# EasyEDA Pro project Priestess.eprj

# Schematic Schematic2
Board Name: Board2; Create Date: 2025-12-09; Page Name: P1; Project Name: Priestess; Schematic Name: Schematic2; Update Date: 2025-12-10; Company: 嘉立创EDA; Page Size: A4; Version: V1.0
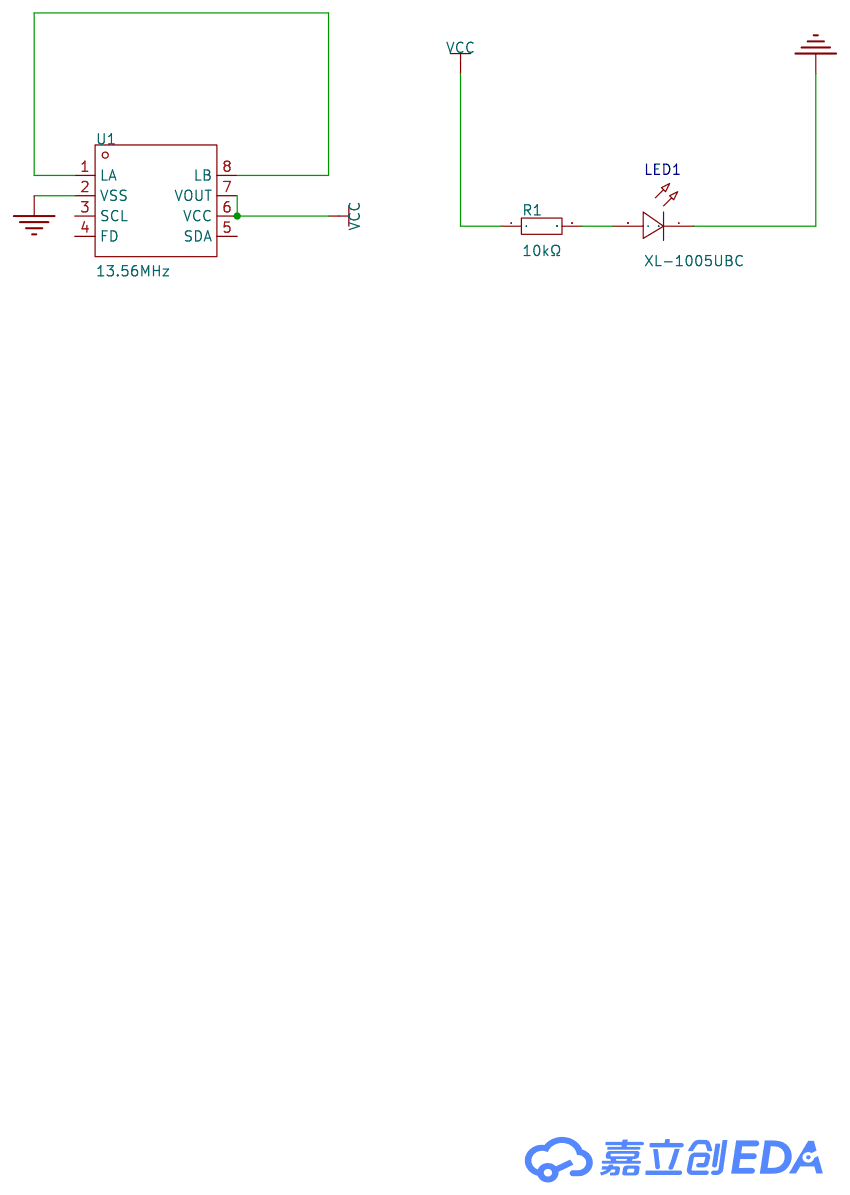
[diagram p0: schematic sheet]

## Parts
LED1  XL-1005UBC  [LED0402-RD]
R1  10kΩ  [R0402]
U1  13.56MHz  [XQFN-8_L1.6-W1.6-P0.50-BL_NT3H2111W0FHKH]

## Library data of the parts
LED1 = XL-1005UBC_C22355736: Supplier Part: C22355736; Manufacturer: XINGLIGHT(成兴光); Supplier Footprint: 0402; JLCPCB Part Class: Extended Part; Datasheet: https://item.szlcsc.com/datasheet/XL-1005UBC/23787446.html; Supplier: LCSC; Illumination Color: 蓝色; Voltage - Forward(Vf): 3.3V; Forward Current: 20mA; Wavelength - Dominant: 455nm~475nm; Peak Wavelength: 465nm; Lens Color: 无色透明透镜; Luminous Intensity: 240mcd; Viewing Angle: 120°; Mounting Style: 正贴
R1 = 0402WGF1002TCE: 电阻类型:厚膜电阻;阻值:10kΩ;精度:±1%;功率:62.5mW;最大工作电压:50V;温度系数:±100ppm/℃;; LCSC Part Name: 10kΩ ±1% 62.5mW 厚膜电阻; Supplier Part: C25744; Manufacturer: UNI-ROYAL(厚声); Supplier Footprint: 0402; JLCPCB Part Class: 基础库; Datasheet: https://atta.szlcsc.com/upload/public/pdf/source/20200306/C422600_1E6D84923E4A46A82E41ADD87F860B5C.pdf; Supplier: LCSC; Type: 厚膜电阻; Tolerance: ±1%; Power(Watts): 62.5mW; Overload Voltage (Max): 50V; Temperature Coefficient: ±100ppm/℃; Operating Temperature Range: -55℃~+155℃
U1 = NT3H2111W0FHKH: 协议:ISO 14443;接口类型:I2C;; Supplier Part: C710403; Manufacturer: NXP(恩智浦); Supplier Footprint: XQFN-8(1.6x1.6); JLCPCB Part Class: 扩展库; Datasheet: https://www.nxp.com/docs/en/data-sheet/NT3H2111_2211.pdf; Supplier: LCSC; agreement: ISO 14443; interface type: I2C; mains input: 3.3V

## Nets
GND: LED1.1(C) U1.2(VSS)
VCC: R1.1 U1.6(VCC) U1.7(VOUT)
$1N388: U1.1(LA) U1.8(LB)
$1N744: LED1.2(A) R1.2

Not connected (* = marked no-connect by the designer): U1 3(SCL) 4(FD) 5(SDA)

# Board PCB2
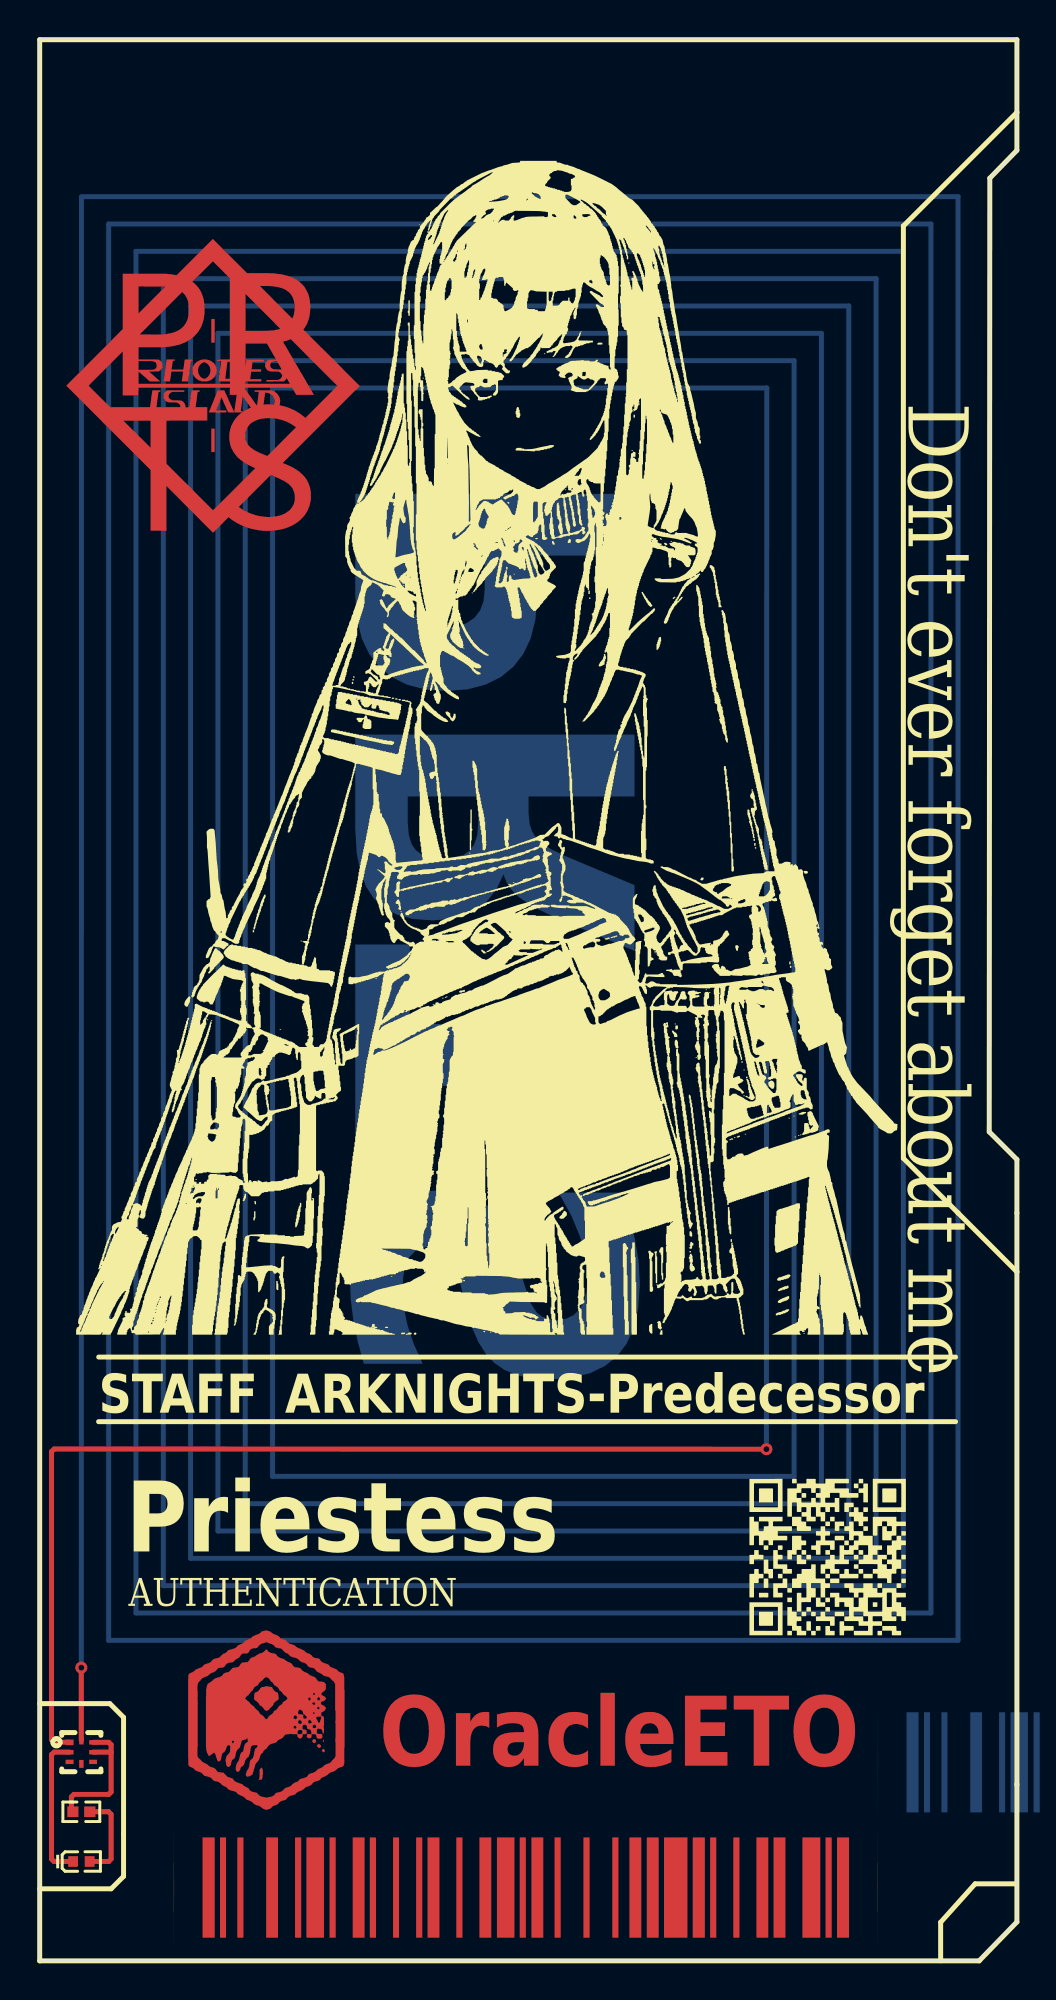
[diagram p1: board, top side]
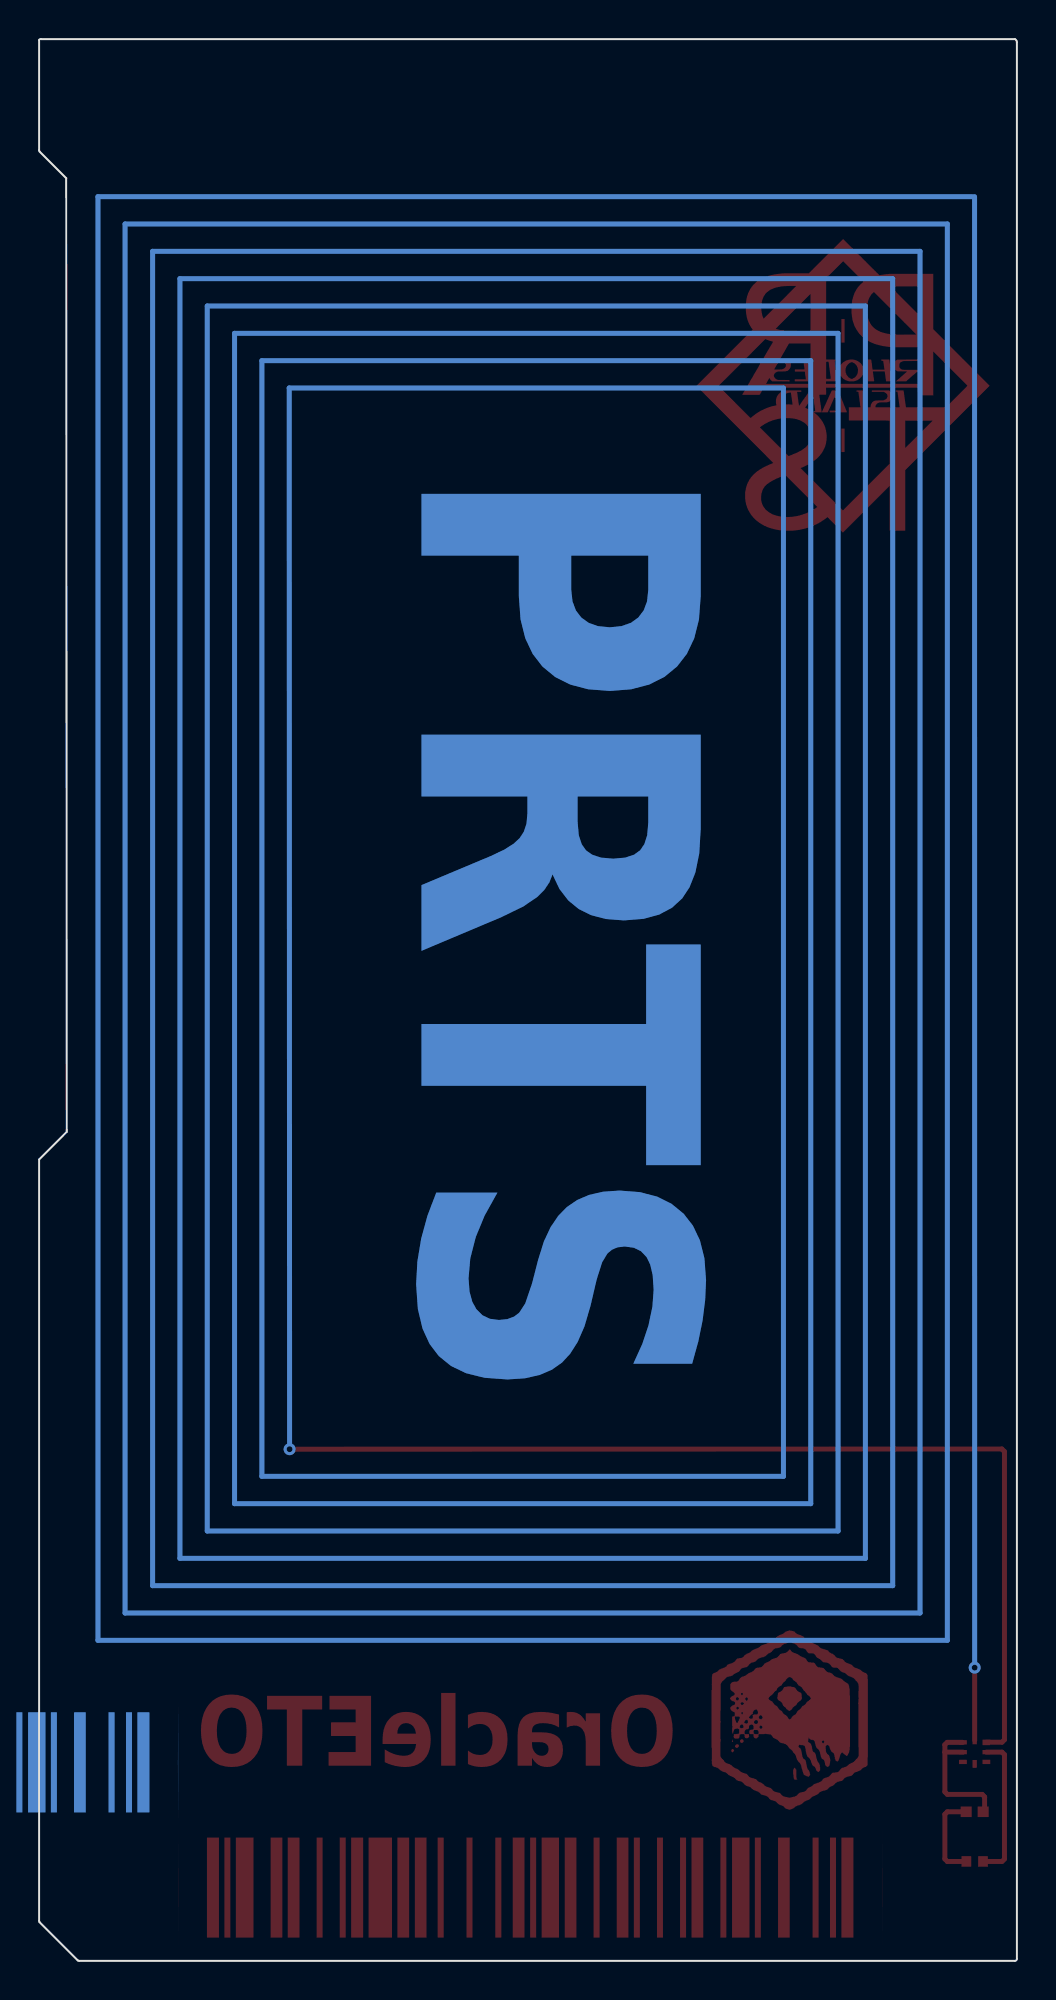
[diagram p2: board, bottom side, seen from below]

Outline 50 x 98.22 mm; copper layers: Top Layer, Bottom Layer. Coordinates in mm from the lower left corner of the outline.
Outline path: 0,98.05 arc(0.02,98.15) 0.1,98.22 49.9,98.22 arc(49.96,98.22) 50,98.16 50,92.54 arc(49.99,92.5) 49.97,92.47 48.62,91.12 48.59,42.46 48.59,42.37 50,40.96 50,2.04 arc(49.99,2) 49.97,1.97 48.03,0.03 arc(48,0.01) 47.96,0 0.1,0 arc(0.03,0.03) 0,0.1 0,98.05
Stack: Top Layer 0.035mm / Dielectric1 1.51mm FR4 er 4.5 / Bottom Layer 0.035mm

## Design rules (mm)
template: JLCPCB Capability(Two Layers Board)
spacing copperThickness1oz (default): track to track 0.102, other pairs 0.152 to 0.3
spacing copperThickness2oz: track to track 0.203, other pairs 0.152 to 0.3
track width copperThickness1oz (default): min 0.127, default 0.254, max 2.54
track width copperThickness2oz: min 0.203, default 0.254, max 2.54
differential pair differentialPair (default): width min 0.127, default 0.254, max 2.54; gap min 0.152, default 0.152
via viaSize (default): diameter min 0.5, default 0.61, max 10; hole min 0.3, default 0.305, max 6.3

## Placement (name value [footprint] x y rotation side)
LED1  XL-1005UBC  [LED0402-RD]  2.16 5.08 0 top
R1  10kΩ  [R0402]  2.16 7.62 0 top
U1  13.56MHz  [XQFN-8_L1.6-W1.6-P0.50-BL_NT3H2111W0FHKH]  2.16 10.67 0 top

## Footprints (pads in the part's own frame, mm; a bottom-side part is the same pattern mirrored in y, then rotated)
LED0402-RD
  rect 0.5x0.54 smd: 1(-0.425,0) 2(0.425,0)
R0402
  rect 0.566x0.54 smd: 1(-0.433,0) 2(0.433,0)
XQFN-8_L1.6-W1.6-P0.50-BL_NT3H2111W0FHKH
  rect 0.4x0.28 smd: 1(-0.6,0.5)
  rect 0.4x0.22 smd: 2(-0.6,0) 3(-0.6,-0.5) 5(0.6,-0.5) 6(0.6,0) 7(0.6,0.5)
  rect 0.22x0.4 smd: 4(0,-0.6) 8(0,0.6)

## Nets
As in the schematic.

Pads without a net: U1 3 4 5

## Via types
v1: diameter 0.61, hole 0.305, Top Layer to Bottom Layer, 2 vias

## Routing (per net, layer and track width the routed paths; a pad name or vN(x,y) marks a point on that pad's centre or on a via; arc(x,y) is an arc through that point)
GND: length 7.5
  Top Layer w0.254: U1.2 0.76,10.67 0.63,10.54 0.63,5.21 0.76,5.08 LED1.1
VCC: length 7.3
  Top Layer w0.254: 2.76,11.17 3.56,11.17 3.68,11.05 3.68,10.67 ; 2.76,10.67 3.68,10.67 ; 3.68,10.67 3.68,8.64 3.56,8.51 1.78,8.51 1.65,8.38 1.65,7.75 1.78,7.62
$1N388: length 1617
  Top Layer w0.254: 1.56,11.18 0.76,11.18 0.64,11.3 0.64,26.04 ; 0.64,26.04 0.77,26.16 v1(37.19,26.15) ; v1(2.16,14.99) U1.8
  Bottom Layer w0.254: 2.17,90.17 v1(2.16,14.99) ; v1(37.19,26.15) 37.21,80.39 11.94,80.39 11.94,24.77 38.61,24.77 38.61,81.79 10.54,81.79 10.54,23.37 40.01,23.37 40.01,83.19 9.14,83.19 9.14,21.97 41.4,21.97 41.4,84.58 7.75,84.58 7.75,20.57 42.8,20.57 42.8,85.98 6.35,85.98 6.35,19.18 44.2,19.18 44.2,87.38 4.95,87.38 4.95,17.78 45.6,17.78 45.6,88.77 3.56,88.77 3.56,16.38 46.99,16.38 46.99,90.17 2.29,90.17
$1N744: length 4.6
  Top Layer w0.254: R1.2 3.56,7.62 3.68,7.49 3.68,5.21 3.56,5.08 LED1.2

Small or netless copper shapes (teardrops, artwork), in the pictures only: 49 on Top Layer, 33 on Bottom Layer

## Text on the board
Bottom Layer: PRTS
Bottom Solder Mask Layer: PRTS
Top Layer: OracleETO
Top Solder Mask Layer: OracleETO
Top Silkscreen Layer: ARKNIGHTS-Predecessor | Priestess | STAFF | AUTHENTICATION | Don't ever forget about me.
